# EasyEDA Pro project sle_keyboard.eprj, board PCB1 (continued)
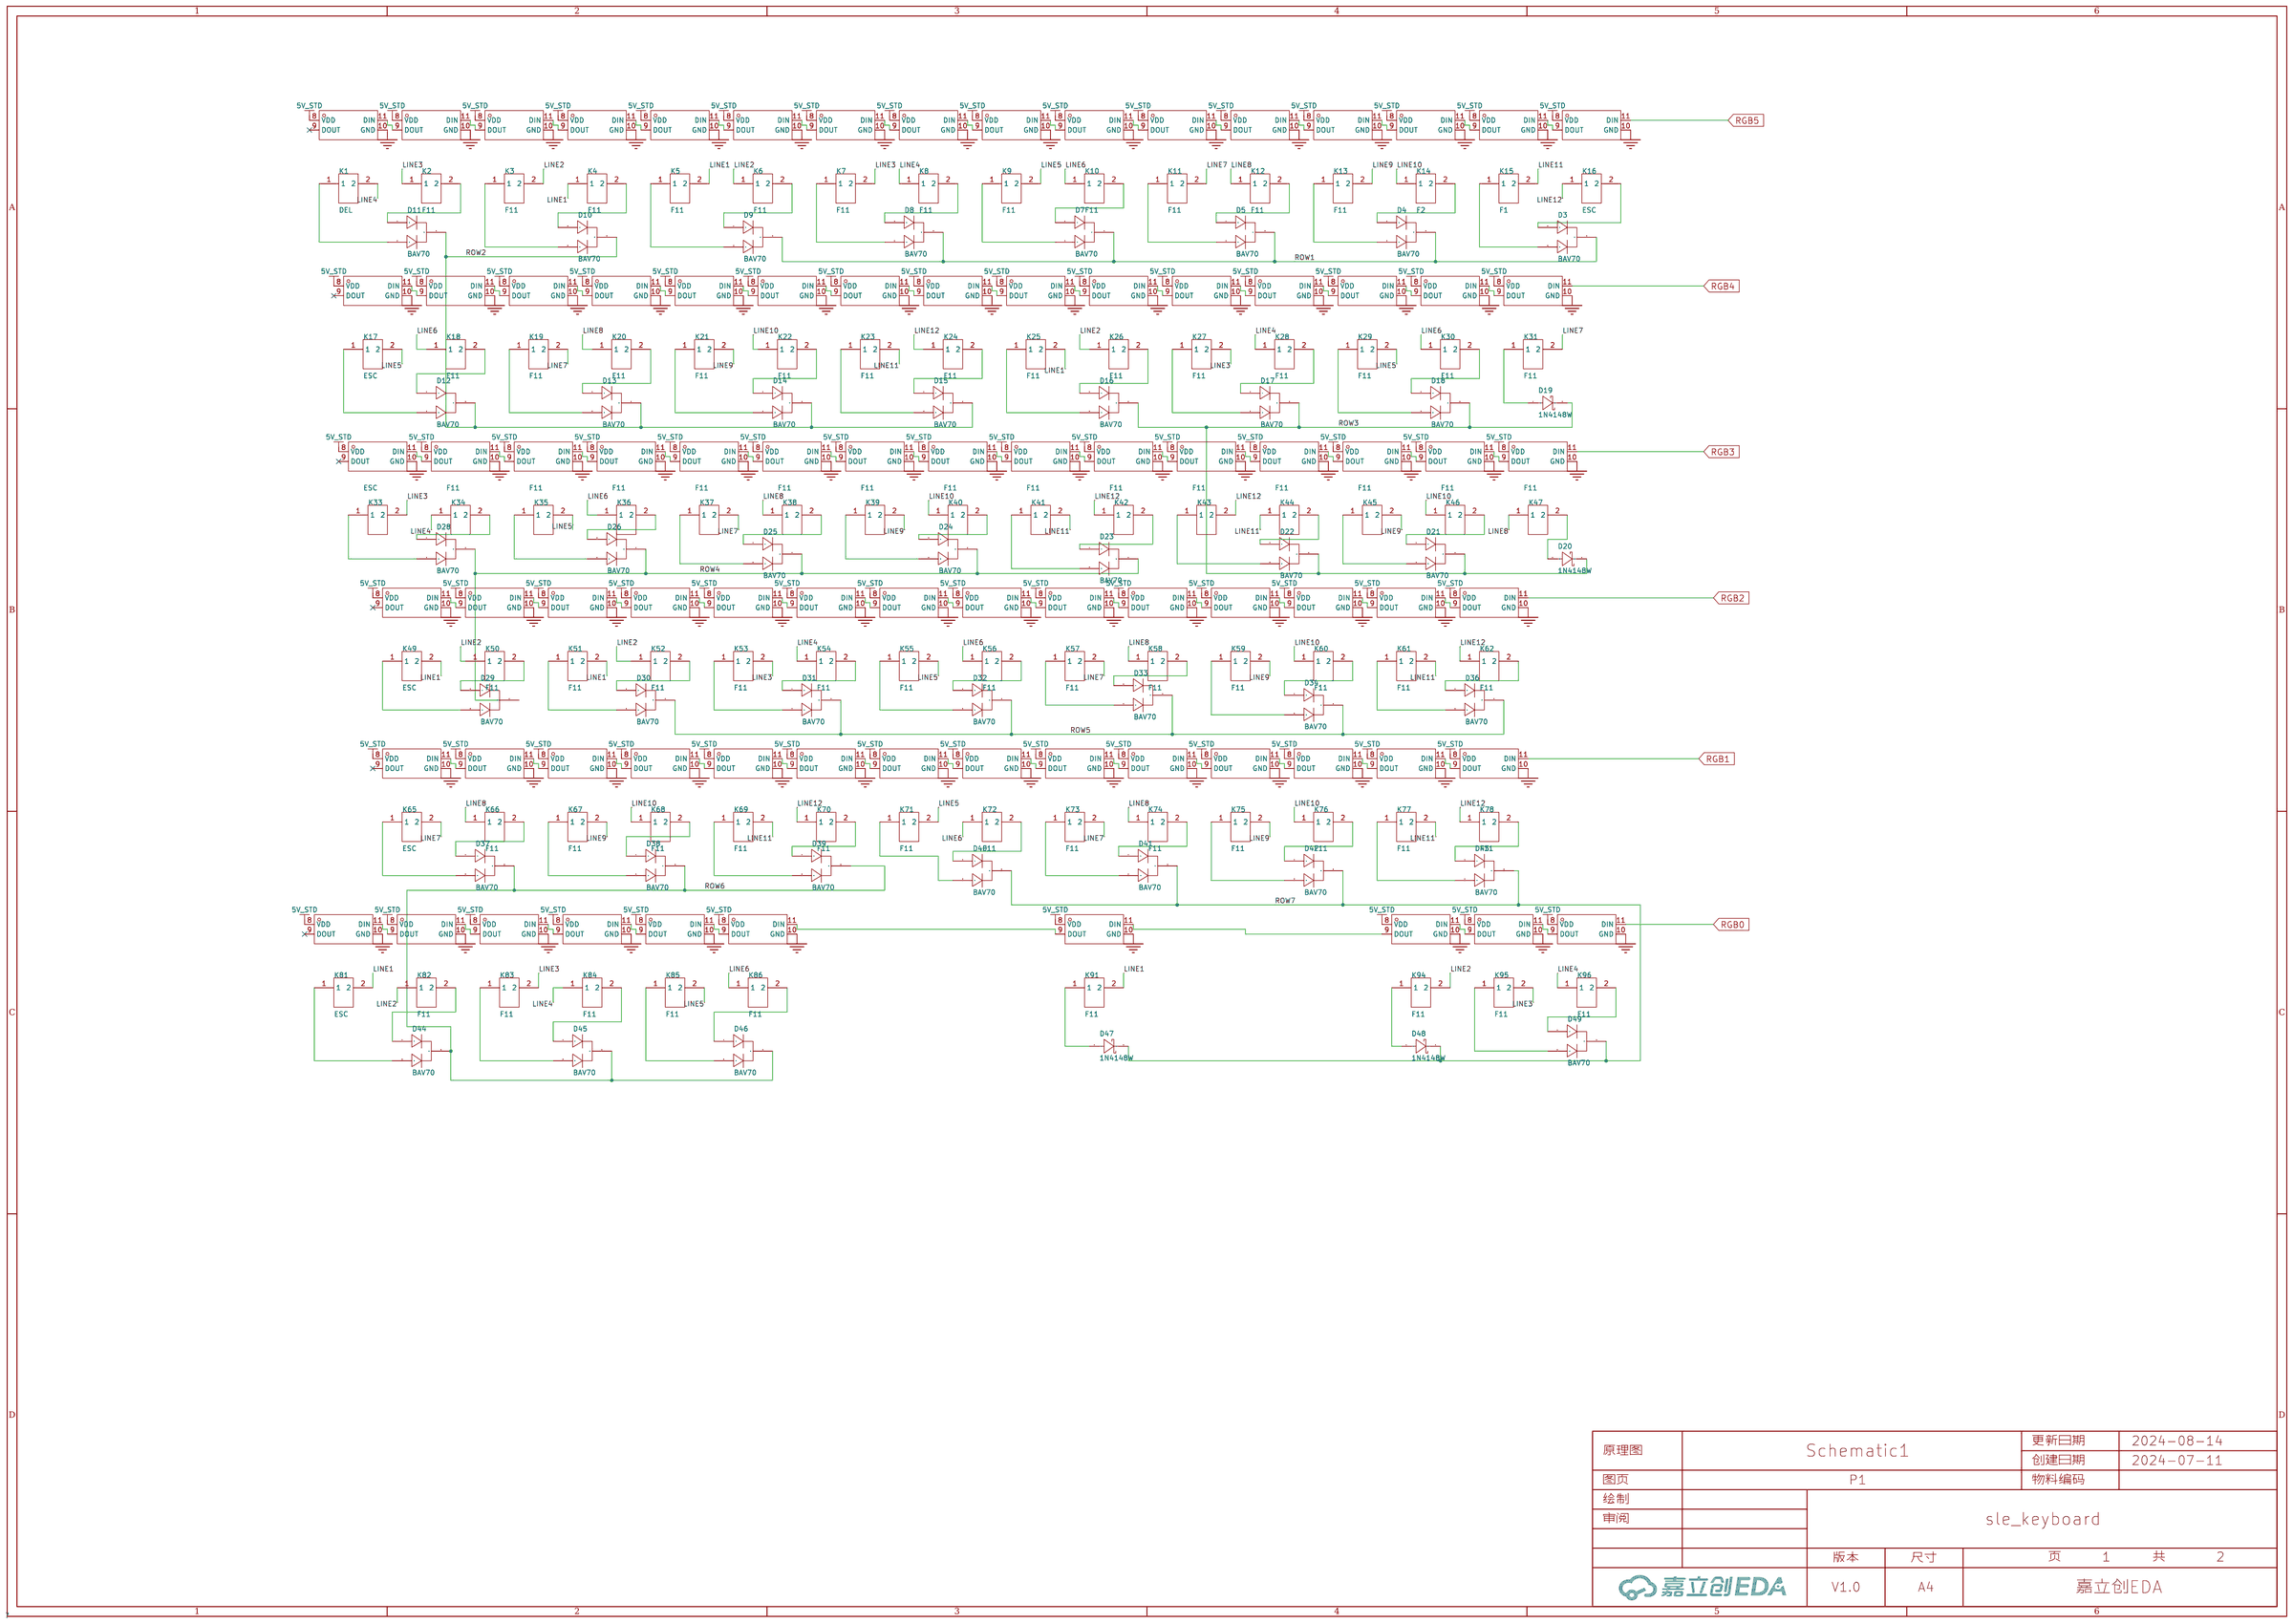
[diagram p0: P1]
## Routing (per net, layer and track width the routed paths; a pad name or vN(x,y) marks a point on that pad's centre or on a via; arc(x,y) is an arc through that point) (continued)
  Bottom Layer w0.178: v1(170.56,63.75) 169.55,62.74 169.55,46.86 167.39,44.7 166.88,44.7 165.74,43.56 165.74,20.32 v1(164.85,19.43) ; v1(180.59,64.39) 180.47,64.26 v1(179.07,64.26) ; v1(28.68,46.89) 28.68,60.55 25.87,63.37 25.87,69.67 25.07,70.47 ; v1(168.28,12.95) 167.89,13.34 v1(167.89,18.42)
ROW5: length 288.4
  Top Layer w0.178: 168.25,11.7 175.22,11.7 176.12,10.8 185.15,10.8 185.75,10.2 188.42,10.2 ; 117.94,52.21 116.75,52.21 114.77,50.22 81.43,50.22 80.55,49.34 80.55,46.55 ; 117.94,52.21 122.68,52.21 124.47,50.42 156.5,50.42 ; 117.94,52.21 118.5,51.64 118.5,48.16 118.51,48.15 ; 156.5,50.42 156.97,49.95 156.97,47.36 157,47.32 ; 156.5,50.42 195.18,50.42 ; 195.64,47.51 195.6,47.56 195.6,50 195.18,50.42 ; 233.52,47.4 233.33,47.58 233.33,49.94 232.85,50.42 195.18,50.42 ; 233.28,47.4 233.28,40.88 234.25,39.91 271.61,39.91 273.24,41.54 ; v1(168.84,39.88) 166.21,42.51 157.4,42.51 157.09,42.82 157.09,47.2 156.97,47.31
  Bottom Layer w0.178: 168.79,39.89 167.77,40.91 167.45,40.91 167.17,40.63 167.17,12.7 v1(168.2,11.67)
ROW6: length 330.9
  Top Layer w0.178: v1(113.79,20.45) 112.4,21.84 109.35,21.84 ; 19.14,9.6 19.14,11.04 v1(19.02,11.16) ; D45.3 56.64,8.3 56.64,1.91 56.52,1.78 ; 109.35,21.84 D39.3 ; 109.35,21.84 106.81,19.3 66.29,19.3 ; v1(180.72,9.91) 180.85,9.91 184.02,6.73 v1(184.02,5.08) 184.84,4.27 185.5,4.27 185.67,4.45 187.05,4.45 189.72,7.11 189.72,7.7 ; D38.3 67.31,26.84 67.31,20.32 66.29,19.3 ; v1(164.47,7.75) 163.96,7.24 160.02,7.24 158.24,5.46 118.75,5.46 v1(113.79,10.41) ; 66.29,19.3 23.88,19.3 18.8,24.38 D37.3 ; 56.52,1.78 21.46,1.78 19.05,4.19 D44.3 ; 56.52,1.78 94.49,1.78 95,2.29 95,8.3 D46.3
  Bottom Layer w0.178: v1(180.72,9.91) 178.31,12.32 171.2,12.32 169.93,11.05 167.89,11.05 167.39,10.54 167.39,8.76 167,8.38 165.1,8.38 v1(164.47,7.75) ; 18.8,27.31 15.88,24.39 15.88,17.3 19.02,14.16 v1(19.02,11.16) ; v1(113.79,20.45) v1(113.79,10.41)
  vias: v1(18.79,27.34)
ROW7: length 245.8
  Top Layer w0.178: 267.39,25.1 267.49,25.2 267.49,29.76 266.24,31.01 229.89,31.01 228.35,32.54 223.16,32.54 ; 223.16,32.54 223.26,32.45 223.26,28.97 223.24,28.96 ; 223.16,32.54 222.18,32.54 221.43,31.79 189.1,31.79 188.51,32.39 185.88,32.39 184.83,31.34 184.83,28.22 ; v1(181.36,8) 182.63,6.73 182.63,4.45 183.13,3.94 186.95,3.94 190.12,7.11 190.12,7.7 ; v1(267.47,23.54) 267.41,23.61 267.41,24.85 ; 282.01,4.84 281.99,4.86 278.57,4.86 276.44,6.98 276.44,10.91 275.58,11.77 265.51,11.77 263.16,14.13 257.33,14.13 256.45,13.25 256.45,12.5 ; 147.49,28.04 147.49,24.13 151.44,20.18 v1(181.96,20.18) 184.14,20.18 185.55,21.59 185.55,27.01 184.83,27.72 ; 161.29,6.17 161.89,5.57 161.89,3.57
  Bottom Layer w0.178: v1(181.96,20.18) 181.96,8.61 v1(181.36,8) ; v1(266.38,11.81) 266.38,22.46 267.47,23.54 ; v1(161.19,6.21) 147.46,19.94 147.46,24.15
  vias: v1(147.47,24.16)
SLE_3V3: length 86.9
  Top Layer w0.127: v2(188.61,14.61) U1.48
  Top Layer w0.508: C5.1 v2(187.38,14.61) v2(188.61,14.61) ; C8.1 195.51,15.36 v2(194.75,14.6) v2(194.75,13.83) 194.75,13.21 ; 186.22,7.27 v2(187.8,7.24) v2(188.56,7.24)
  Top Layer w0.762: C22.1 154.21,10.06 Q1.2 U5.1
  Top Layer w1.016: v1(152.65,7.87) 152.78,8 153.42,8 v1(153.54,7.87) 153.67,8 154.36,8 v1(154.48,7.87)
  Bottom Layer w0.127: v2(188.61,14.61) 188.61,14.6
  Bottom Layer w0.508: 188.61,13.83 188.16,13.83 v2(187.38,14.61) v1(187.38,13.7) 187.38,7.65 v2(187.8,7.24) ; 188.61,13.83 v1(188.61,8) 188.61,7.29 v2(188.56,7.24) ; 188.61,13.83 v2(194.75,13.83) ; 188.61,13.83 v2(188.61,14.61) ; v2(194.75,14.6) 188.61,14.6
  Bottom Layer w0.762: v1(188.61,8) v1(187.74,8) 187.19,8 186.18,6.99 175.26,6.99 172.59,4.32 160.53,4.32 156.97,7.87 v1(154.48,7.87) v1(153.54,7.87) v1(152.65,7.87) ; v1(153.54,8.64) v1(152.65,8.64) v1(151.89,8.64)
  vias: v1(187.89,14.13) v1(188.59,13.72)
SLE_DBG_RX: length 9.3
  Top Layer w0.178: NOREF#9.TP4 188.98,1.52 190.12,1.52 191.01,2.41 192.02,2.41 192.91,3.3 192.91,5.84 193.32,6.25 193.32,7.7
SLE_DBG_TX: length 11.4
  Top Layer w0.178: NOREF.TP5 187.33,2.41 190.25,2.41 190.63,2.79 191.9,2.79 192.53,3.43 192.53,6.1 192.92,6.48 192.92,7.7
SLE_USB_N: length 133.3
  Top Layer w0.203: v1(183.77,9.91) 183.83,9.91 183.97,9.77 187.79,9.77 187.81,9.8 U1.9
  Top Layer w0.28: 228.22,91.11 228.22,91.53 228.51,91.83 228.51,91.97 227.64,92.84 209.04,92.84 v1(208.41,93.47) ; 227.08,91.24 228.22,91.24
  Bottom Layer w0.28: v1(208.41,93.47) 208.66,93.22 208.66,79.25 212.04,75.87 212.04,65.74 207.47,61.16 207.47,46.69 203.91,43.13 203.91,22.02 202.49,20.6 187.25,20.6 186.26,19.61 186.26,13.16 184.28,11.18 184.28,10.86 183.77,10.35 v1(183.77,9.91)
SLE_USB_P: length 133.3
  Top Layer w0.203: 184.15,9.15 184.42,9.42 187.79,9.42 187.81,9.4 U1.10
  Top Layer w0.28: v1(209.3,93.47) 209.5,93.27 227.95,93.27 228.94,92.27 228.94,91.95 229.24,91.66 R12.2 230.38,91.24
  Bottom Layer w0.28: v1(209.3,93.47) 209.09,93.27 209.09,79.43 212.47,76.05 212.47,65.56 207.9,60.99 207.9,46.51 204.34,42.95 204.34,21.84 202.66,20.17 187.42,20.17 186.69,19.43 186.69,12.98 184.71,11 184.71,9.7 v1(184.15,9.14)
SWD_CLK: length 3.6
  Top Layer w0.254: NOREF#3.TP2 194.69,2.16 R2.2
SWD_DAT: length 3.4
  Top Layer w0.254: R1.2 196.72,1.65 NOREF#8.TP1
SYS_3V3: length 167.2
  Top Layer w0.178: v1(21.02,46.89) 20.31,46.18 20.07,46.18
  Top Layer w0.254: v1(150.5,14.86) 150.06,15.29 R21.2
  Top Layer w1.016: 149.13,10.8 v1(146.08,10.8) 137.16,10.8 129.54,18.42 v1(42.55,18.42) v1(41.79,18.42) v1(41.01,18.42)
  Bottom Layer w0.254: v1(150.5,14.86) 146.43,10.8 v1(146.08,10.8) ; 26.41,47.24 21.37,47.24 v1(21.02,46.89)
  Bottom Layer w0.762: 26.41,47.24 26.42,47.24
  Bottom Layer w1.016: 26.42,51.29 26.41,51.28 26.41,46.38 39.32,33.47 39.32,19.86 40.74,18.44 43.52,18.44
  vias: v1(25.75,51.83) v1(25.7,51.05) v1(26.42,51.08) v1(26.45,51.84) v1(27.11,51.83) v1(27.12,51.09)
USB_N: length 22.6
  Top Layer w0.28: R9.1 228.45,88.34 228.55,88.24 228.55,86.49 229.18,85.85 231.24,85.85 233.68,88.29 243.2,88.29 243.55,88.65 243.55,91.31 243.93,91.69 CN2.3
USB_P: length 22.8
  Top Layer w0.28: CN2.4 244.78,92.96 243.59,92.96 243.12,92.49 243.12,88.82 243.02,88.73 233.5,88.73 231.06,86.28 229.36,86.28 228.98,86.66 228.98,88.24 229.08,88.34 R10.1
$1N13661: length 13.1
  Top Layer w0.178: v1(243.22,109.06) 243.09,109.2 241.24,109.2 ; 253.68,110.69 251.46,110.69 250.08,109.31
  Bottom Layer w0.178: 243.25,109.1 249.88,109.1 v1(250.07,109.28)
$1N13668: length 12.9
  Top Layer w0.178: 272.83,110.87 270.12,110.87 269.84,110.59 ; 260.51,109.16 v1(262.26,109.16)
  Bottom Layer w0.178: v1(269.77,110.56) 268.38,109.16 v1(262.26,109.16)
$1N13672: length 14.2
  Top Layer w0.178: 279.75,109.04 281.34,109.04 v1(281.43,109.12) ; 292.33,110.58 291.26,111.66 291.26,111.68
  Bottom Layer w0.178: v1(281.43,109.12) 284.01,111.71 v1(291.27,111.71)
$1N13676: length 13.2
  Top Layer w0.178: 222.19,109.12 224.14,109.12 v1(224.17,109.16) ; 234.79,110.6 231.59,110.6 230.92,109.93
  Bottom Layer w0.178: v1(224.17,109.16) 230.17,109.16 v1(230.91,109.89)
$1N13680: length 14.1
  Top Layer w0.178: v1(205.2,109.04) 205.03,109.21 202.85,109.21 ; 216.15,110.57 212.87,110.57 212.15,109.85
  Bottom Layer w0.178: v1(212.11,109.84) 211.33,109.06 205.09,109.06
$1N13684: length 13.6
  Top Layer w0.178: 196.87,110.56 194.26,110.56 192.82,109.12 ; 183.96,109.23 185.73,109.23 v1(185.82,109.15)
  Bottom Layer w0.178: v1(185.82,109.15) 185.85,109.12 v1(192.84,109.12)
$1N13688: length 13.5
  Top Layer w0.178: 164.91,109.11 v1(167.73,109.11) ; 177.77,110.61 174.56,110.61 173.59,109.63
  Bottom Layer w0.178: v1(173.62,109.67) 173.05,109.11 v1(167.73,109.11)
$1N13692: length 13.5
  Top Layer w0.178: 145.83,109.13 145.87,109.17 151.99,109.17 153.41,110.59 158.77,110.59
$1N13696: length 13.4
  Top Layer w0.178: 131.78,109.01 131.75,109.04 127.01,109.04 ; 134.75,109.27 136.23,110.76 139.72,110.76
  Bottom Layer w0.178: v1(131.73,109.09) 134.62,109.09 v1(134.72,109.19)
$1N13700: length 13.8
  Top Layer w0.178: 120.81,110.67 114.56,110.67 113.01,109.13 107.65,109.13 107.64,109.15
$1N13704: length 13.7
  Top Layer w0.178: 88.67,109.13 91.87,109.13 v1(91.88,109.13) ; 96.36,109.13 97.72,110.48 101.79,110.48
  Bottom Layer w0.178: v1(91.88,109.13) 91.92,109.16 v1(96.39,109.16)
$1N13708: length 15
  Top Layer w0.178: 82.62,110.52 82.62,111.15 81.93,111.84 ; 69.69,109.11 71.69,109.11 v1(71.79,109.21)
  Bottom Layer w0.178: v1(71.79,109.21) 74.43,111.85 v1(81.93,111.85)
$1N13712: length 13.2
  Top Layer w0.178: 50.89,108.99 54.59,108.99 54.67,109.07 ; 63.18,110.51 62.88,110.8 58.72,110.8
  Bottom Layer w0.178: v1(58.73,110.78) 56.97,109.01 v1(54.66,109.01)
$1N13716: length 13.6
  Top Layer w0.178: 31.31,109.17 31.32,109.16 37.46,109.16 38.82,110.52 44.36,110.52
$1N13720: length 13.9
  Top Layer w0.178: v1(16.5,109.39) 16.26,109.15 12.44,109.15 ; 25.75,110.64 19.88,110.64 19.21,109.97
  Bottom Layer w0.178: v1(19.21,109.96) 18.66,109.4 16.54,109.4
$1N13724: length 23.7
  Top Layer w0.178: 35.3,91.8 28.59,91.8 28.31,92.09 ; 16.25,91.25 14.94,89.95 12.62,89.95 ; 18.83,91.45 19.42,92.04 v1(24.42,92.04)
  Bottom Layer w0.178: v1(16.3,91.46) 16.3,91.46 v1(18.88,91.46) ; v1(28.4,92.07) 24.44,92.07 24.4,92.03
$1N13728: length 24.6
  Top Layer w0.178: 57.96,89.83 59.6,91.46 63.67,91.46 ; 41.15,90.16 54.24,90.16 55.66,91.58
  Bottom Layer w0.178: v1(57.99,89.74) 57.61,89.74 v1(55.71,91.65)
$1N13732: length 14.3
  Top Layer w0.178: 82.06,91.9 81.57,91.9 79.69,90.02 76.36,90.02 74.6,91.78 73.06,91.78 ; v1(71.11,90.11) 71.06,90.06 69.93,90.06
  Bottom Layer w0.178: v1(71.11,90.11) 71.3,90.11 v1(72.99,91.79)
$1N13736: length 14.2
  Top Layer w0.178: 101.48,91.81 100.74,92.56 v1(100.74,92.58) ; 88.67,90.04 95.67,90.04 v1(98.16,92.53)
  Bottom Layer w0.178: v1(98.16,92.53) 98.21,92.58 v1(100.74,92.58)
$1N13740: length 14
  Top Layer w0.178: 116.84,92.65 114.3,90.11 108.08,90.11 ; 120.46,91.43 119.32,92.58 119.2,92.58
  Bottom Layer w0.178: 116.81,92.69 116.88,92.62 v1(119.22,92.62)
  vias: v1(116.86,92.61)
$1N13744: length 14.1
  Top Layer w0.178: 136.88,91.1 135.78,89.99 127.23,89.99 ; 139.92,91.53 139.39,91.53 v1(138.44,92.48)
  Bottom Layer w0.178: v1(138.44,92.48) 137.1,91.14 v1(136.87,91.14)
$1N13748: length 13.4
  Top Layer w0.178: 145.81,90.14 155.3,90.14 155.36,90.08 ; 158.38,91.55 158.16,91.32 157.6,91.32 ; 155.37,90.08 155.79,89.67
  Bottom Layer w0.178: v1(157.47,91.38) 155.8,89.7 155.8,89.7
  vias: v1(155.8,89.66)
$1N13752: length 13.4
  Top Layer w0.178: 175.79,92.22 176.31,91.7 177.53,91.7 ; 165.26,90.09 171.85,90.09 173.94,92.17
  Bottom Layer w0.178: v1(175.81,92.19) 173.94,92.19 v1(173.93,92.2)
$1N13756: length 13.6
  Top Layer w0.178: 193.71,90.63 193.15,90.07 184.08,90.07 ; 196.78,91.63 195.71,91.63 195.25,92.1
  Bottom Layer w0.178: v1(193.77,90.69) 195.19,92.11 v1(195.24,92.11)
$1N13760: length 15.8
  Top Layer w0.178: 207.14,89.49 203.32,89.49 202.84,89.96 ; 215.84,91.69 207.83,91.69 207.49,92.04
  Bottom Layer w0.178: v1(207.54,92.14) 207.54,89.74 v1(207.28,89.48)
$1N13764: length 16.9
  Top Layer w0.178: 222.15,90.29 224.5,90.29 225.59,89.2 226.1,89.2 226.59,88.71 ; 233.76,92.94 234.93,91.78 234.93,91.63
  Bottom Layer w0.178: v1(226.54,88.78) 231.54,88.78 232.61,89.86 232.61,91.88 v1(233.68,92.96)
$1N13768: length 30.3
  Top Layer w0.178: 253.85,91.53 254.09,91.77 254.09,93.02 ; 251.39,91.54 251.38,91.53 v1(249.36,91.53)
  Top Layer w0.508: K28.11 241.07,90.04 v1(242.44,90.04)
  Bottom Layer w0.178: v1(242.44,90.04) 242.44,91.34 239.46,94.33 239.46,96.81 247.14,96.81 249.34,94.6 249.34,91.56 ; v1(251.33,91.55) 252.84,93.06 v1(254.11,93.06)
$1N13772: length 19.3
  Top Layer w0.178: 262.46,95.59 268.83,95.59 272.77,91.66 ; v1(262.41,90.15) 262.3,90.04 260.51,90.04
  Bottom Layer w0.178: v1(262.41,90.15) 262.44,90.18 v1(262.44,95.57)
$1N13776: length 13.2
  Top Layer w0.178: 292.27,91.66 292.21,91.59 286.44,91.59 285.08,90.23 279.7,90.23
$1N13780: length 20.6
  Top Layer w0.178: 30.36,72.58 23.45,72.58 22.26,71.4 ; 13.01,70.92 13.4,70.92 14.56,72.08 ; v1(15.61,70.18) 15.62,70.19 17.58,70.19 19.25,71.86 v1(20.29,71.86)
  Bottom Layer w0.178: v1(14.61,72.15) 15.61,71.15 v1(15.61,70.18) ; v1(22.33,71.4) 21.87,71.86 v1(20.29,71.86)
$1N13784: length 19.2
  Top Layer w0.178: 54.04,72.42 53.02,73.44 52.28,73.44 ; 49.17,73.44 46.67,70.94 36.33,70.94
  Bottom Layer w0.178: v1(49.23,73.45) 52.34,73.45 v1(52.38,73.41)
$1N13788: length 14.5
  Top Layer w0.178: 72.88,72.58 71.68,73.78 70.63,73.78 ; 68.57,73.8 65.75,70.98 59.99,70.98
  Bottom Layer w0.178: v1(70.65,73.79) 68.66,73.79 v1(68.64,73.82)
$1N13792: length 15.7
  Top Layer w0.178: 92.27,72.6 90.79,72.6 90.68,72.49 ; 90.62,70.2 89.67,70.2 88.85,71.02 79.08,71.02
  Bottom Layer w0.178: v1(90.54,72.44) 90.54,70.46 v1(90.67,70.34)
$1N13796: length 14.1
  Top Layer w0.178: 110.94,72.7 108.88,72.7 108.83,72.75 ; 98.17,71.02 106,71.02 106.48,70.55
  Bottom Layer w0.178: v1(106.42,70.53) 106.64,70.53 v1(108.91,72.81)
$1N13800: length 14.6
  Top Layer w0.178: v1(127.83,71.5) 127.22,70.89 117.52,70.89 ; 129.61,73.55 130,73.15 130,72.5
  Bottom Layer w0.178: v1(129.58,73.6) 127.83,71.85 v1(127.83,71.5)
$1N13804: length 14.7
  Top Layer w0.178: 149.51,72.52 144.64,72.52 143.75,73.42 ; 136.37,71.03 141.28,71.03 142.68,72.43
  Bottom Layer w0.178: v1(143.77,73.42) 142.64,72.29 v1(142.57,72.29)
$1N13808: length 13.8
  Top Layer w0.178: 155.39,71.04 155.41,71.01 162.17,71.01 163.73,72.57 168.52,72.57
$1N13812: length 13.9
  Top Layer w0.178: 174.32,70.98 174.37,71.02 179.44,71.02 180.96,72.54 187.57,72.54
$1N13816: length 13.6
  Top Layer w0.178: 193.43,71.02 193.44,71.03 197.7,71.03 199.26,72.59 206.36,72.59
$1N13820: length 13.7
  Top Layer w0.178: 224.21,72.3 224.82,72.3 225.05,72.53 225.71,72.53 ; v1(222.86,71.06) 222.7,71.22 213.28,71.22 213.03,70.98
  Bottom Layer w0.178: v1(224.19,72.28) 224.19,71.85 223.41,71.06 v1(222.86,71.06)
$1N13824: length 16.4
  Top Layer w0.178: 242.07,72.2 242.37,72.49 244.77,72.49 ; 231.39,71.15 233.93,71.15 235.58,69.5 241.41,69.5 241.97,70.06
  Bottom Layer w0.178: v1(242.05,72.22) 242.05,70.18 v1(242.03,70.16)
$1N13828: length 14.2
  Top Layer w0.178: 258.96,72.3 257.7,71.03 251.14,71.03 ; 263.79,72.54 261.72,72.54 260.63,73.63
  Bottom Layer w0.178: v1(259,72.33) 259.36,72.33 v1(260.67,73.63)
$1N13832: length 19.4
  Top Layer w0.178: v1(275.83,70.99) 275.73,70.89 269.69,70.89 ; 285.45,74.03 285.76,74.03 287.21,72.58
  Bottom Layer w0.178: v1(285.43,74.04) 278.82,74.04 275.82,71.05
$1N13836: length 33
  Top Layer w0.178: 37.15,54.83 37.01,54.69 37.01,53.37 ; 12.55,51.94 13.96,51.94 14.74,52.72 ; 14.76,56.96 15.55,57.75 v1(30.79,57.75)
  Bottom Layer w0.178: 30.79,57.73 31.26,57.26 31.26,55.77 31.37,55.66 36.19,55.66 v1(37.07,54.78) ; v1(14.78,56.97) 14.78,52.8 v1(14.75,52.78)
$1N13840: length 29.4
  Top Layer w0.178: 43.89,52.07 64.23,52.07 66.39,49.91 ; 68.11,53.51 67.3,54.32 66.95,54.32
  Bottom Layer w0.178: v1(66.4,49.94) 66.71,50.25 v1(66.71,54.3)
$1N13844: length 15.7
  Top Layer w0.178: 74.75,52.07 84.47,52.07 85.04,51.5 ; 87.79,53.42 87.79,54.36 87.73,54.42
  Bottom Layer w0.178: v1(85.05,51.5) 87.73,54.18 v1(87.73,54.53)
$1N13848: length 13.1
  Top Layer w0.178: 93.74,52 93.81,52.07 99.26,52.07 100.58,53.4 106.26,53.4
$1N13852: length 16
  Top Layer w0.178: 121.33,53.08 113.89,53.08 112.73,51.92 ; 125.74,53.54 124.06,53.54 123.88,53.36
  Bottom Layer w0.178: v1(123.95,53.45) 123.95,52.05 123.65,51.76 122.09,51.76 121.4,52.46 v1(121.4,53.05)
$1N13856: length 16
  Top Layer w0.178: 144.61,53.43 144.61,54.39 ; 142.12,51.3 141.6,51.82 131.39,51.82
  Bottom Layer w0.178: v1(142.14,51.3) 144.63,53.79 v1(144.63,54.4)
$1N13904: length 21.6
  Top Layer w0.178: 284.83,53.37 283.27,54.93 281.62,54.93 ; 265.05,51.98 271.31,51.98 274.23,54.91
  Bottom Layer w0.178: v1(281.58,54.94) 274.28,54.94 v1(274.25,54.91)
$1N13908: length 14.7
  Top Layer w0.178: 256.03,55.35 256.36,55.35 258.32,53.39 ; 245.76,51.98 252.58,51.98 254.08,53.48
  Bottom Layer w0.178: v1(254.14,53.49) 254.14,53.54 v1(256,55.41)
$1N13916: length 19.7
  Top Layer w0.178: 239.45,55.12 239.7,54.87 239.7,53.4 ; 239.59,50.42 239.58,50.41 238.04,50.41 236.51,51.94 227.19,51.94
  Bottom Layer w0.178: v1(239.42,55.17) 239.42,50.72 v1(239.66,50.48)
$1N13920: length 14.6
  Top Layer w0.178: 220.63,53.39 219.41,54.61 217.17,54.61 ; 207.69,52.02 214.45,52.02 215.46,53.03
  Bottom Layer w0.178: v1(217.2,54.62) 215.56,52.99 v1(215.45,52.99)
$1N13924: length 14.6
  Top Layer w0.178: 201.89,53.41 200.9,53.41 200.26,54.05 ; 188.43,52.08 195.83,52.08 197.79,54.04
  Bottom Layer w0.178: v1(200.32,54.04) v1(197.8,54.04)
$1N13928: length 15.2
  Top Layer w0.178: 169.69,51.98 179.33,51.98 v1(179.74,51.57) ; 182.5,53.55 181.73,54.31 181.22,54.31
  Bottom Layer w0.178: v1(179.74,51.57) 181.23,53.07 v1(181.23,54.34)
$1N13932: length 14.7
  Top Layer w0.178: 159.47,54.03 157.46,52.03 150.25,52.03 ; 163.78,53.37 162.44,53.37 161.76,54.05
  Bottom Layer w0.178: v1(161.78,54.06) 159.51,54.06 v1(159.46,54.01)
$1N13936: length 26.9
  Top Layer w0.178: 273.35,33.41 272.71,32.77 255.1,32.77 ; 280.38,34.28 279.04,35.62 276.95,35.62
  Bottom Layer w0.178: v1(273.37,33.47) 274.58,33.47 v1(276.86,35.75)
$1N13940: length 15.9
  Top Layer w0.178: 249.47,34.35 248.86,34.96 247.95,34.96 ; 246.44,31.99 245.57,32.86 236.35,32.86
  Bottom Layer w0.178: v1(248.01,34.98) 246.43,33.41 v1(246.43,32)
$1N13944: length 14.6
  Top Layer w0.178: 229.95,34.5 229.95,34.89 229.18,35.66 ; 226.9,35.49 220.87,35.49 218.19,32.81 217.2,32.81
  Bottom Layer w0.178: v1(229.18,35.6) 226.95,35.6 v1(226.91,35.56)
$1N13948: length 14.8
  Top Layer w0.178: 208.38,33.38 207.89,32.89 198.18,32.89 ; 211.43,34.41 210.5,35.34 210,35.34
  Bottom Layer w0.178: v1(209.94,35.32) 209.94,34.92 v1(208.43,33.41)
$1N13952: length 14.3
  Top Layer w0.178: 179.42,32.99 186.68,32.99 v1(189.07,35.38) ; 190.81,35.34 191.44,35.34 192.34,34.44
  Bottom Layer w0.178: v1(190.81,35.34) 190.78,35.38 v1(189.07,35.38)
$1N13956: length 18.4
  Top Layer w0.178: 173.21,35.34 173.04,35.17 173.04,34.48 ; 173.18,31.53 171.93,31.53 170.52,32.94 160.11,32.94
  Bottom Layer w0.178: v1(173.24,35.32) 173.24,31.59 v1(173.18,31.53)
$1N13960: length 14.8
  Top Layer w0.178: v1(150.13,35.45) 147.53,32.85 141.44,32.85 ; 154.19,35.39 154.2,35.38 154.2,34.44
  Bottom Layer w0.178: v1(150.13,35.45) 150.14,35.44 v1(154.21,35.44)
$1N13964: length 18.3
  Top Layer w0.178: 121.97,32.93 123.1,31.8 v1(135.18,31.8) ; 135.21,34.45 135.21,35.29 135.29,35.38
  Bottom Layer w0.178: v1(135.18,31.8) 135.26,31.87 v1(135.26,35.4)
$1N13968: length 18
  Top Layer w0.178: 116.07,34.47 115.23,35.31 115.09,35.31 ; 103.1,33.07 112.6,33.07 114.28,31.4 115.11,31.4 115.13,31.37
  Bottom Layer w0.178: v1(115.19,31.36) 115.13,31.41 v1(115.13,35.3)
$1N13972: length 17.4
  Top Layer w0.178: 97.09,34.41 97.09,34.47 96.24,35.33 ; v1(96.16,31.88) 96.14,31.87 94.94,31.87 93.92,32.89 83.98,32.89
  Bottom Layer w0.178: v1(96.22,35.36) 96.22,31.95 v1(96.16,31.88)
$1N13976: length 35.6
  Top Layer w0.178: 13.51,32.86 13.5,32.87 ; 13.51,32.86 12.61,32.86 ; 13.51,32.86 13.57,32.86 14.96,31.46 16.64,31.46 17.05,31.88 20.68,31.88 22.2,30.36 v1(22.62,30.36) ; 25.59,35.8 25.48,35.69 25.48,34.34
  Bottom Layer w0.178: v1(25.59,35.62) 33.06,35.62 33.25,35.43 33.25,31.71 32.41,30.87 27.18,30.87 26.6,30.3 22.65,30.3 22.6,30.35
$1N13980: length 24.6
  Top Layer w0.178: 51.33,34.43 51.33,34.9 50.85,35.39 ; 31.83,32.89 39.08,32.89 42.91,36.72 50.77,36.72 51.28,37.23 51.42,37.23
  Bottom Layer w0.178: v1(50.8,35.4) 51.39,35.99 v1(51.39,37.25)
$1N13984: length 24.8
  Top Layer w0.178: 76.74,31.86 58.68,31.86 57.51,33.03 ; 76.82,35.27 77.17,35.27 78.02,34.42
  Bottom Layer w0.178: v1(76.77,35.32) 76.77,31.86 v1(76.74,31.84)
$1N13988: length 15.9
  Top Layer w0.178: 12.8,14.03 16.01,14.03 17.32,15.33 21.78,15.33 ; 25.83,15.41 26.3,15.88 26.3,16.51
  Bottom Layer w0.178: v1(26.37,16.52) 22.97,16.52 21.79,15.34
  vias: v1(21.7,15.31)
$1N13992: length 15.2
  Top Layer w0.178: 43.18,15.39 43.2,15.38 44.65,15.38 ; 41.69,12.97 40.91,13.75 31.39,13.75
  Bottom Layer w0.178: v1(41.67,12.99) 41.67,13.91 v1(43.2,15.45)
$1N13996: length 22.4
  Top Layer w0.178: 50.52,13.87 54.22,13.87 55.72,15.36 ; v1(63.43,20.6) 63.42,20.61 v1(60.99,20.61) ; 63.51,15.5 62.97,16.05
  Bottom Layer w0.178: 61.01,20.59 60.99,20.57 58.99,20.57 58.99,18.57 v1(55.74,15.33) ; v1(62.97,16.05) 63.42,16.51 63.42,20.61
$1N14000: length 14.2
  Top Layer w0.178: 77.61,15.41 76.09,13.89 69.54,13.89 ; 81.24,15.79 81.65,15.38 82.98,15.38
  Bottom Layer w0.178: v1(81.23,15.79) 81.02,15.58 v1(77.72,15.58)
$1N14004: length 14.8
  Top Layer w0.178: 97.92,14.58 97.2,13.86 88.87,13.86 ; 101.98,15.33 101.34,15.33 100.13,16.55
  Bottom Layer w0.178: v1(100.18,16.54) 98.24,14.6 v1(97.91,14.6)
$1N14008: length 19.2
  Top Layer w0.178: v1(262.74,16.25) 256.41,16.25 254.02,13.86 248.09,13.86 ; 265.37,16.22 265.93,15.66 265.93,15.49
  Bottom Layer w0.178: v1(262.74,16.25) 262.75,16.26 v1(265.38,16.26)
$1N14012: length 20.2
  Top Layer w0.178: 272.12,13.92 283.08,13.92 286.06,16.9 ; v1(289.9,16.85) 289.88,16.83 289.88,15.68
  Bottom Layer w0.178: v1(289.9,16.85) 286.19,16.85 v1(286.11,16.93)
$1N14016: length 75
  Top Layer w0.178: v1(241.61,16.93) 241.99,16.55 241.99,15.58 ; 176.65,13.87 177.73,13.87 182.91,19.06 183.63,19.06 188.2,23.62 192.31,23.62 192.31,23.66 192.79,24.13 194.17,24.13 197.08,21.22 231.83,21.22 237.68,15.37
  Bottom Layer w0.178: v1(237.73,15.39) 239.27,16.93 v1(241.61,16.93)
$1N14021: length 73.4
  Top Layer w0.178: 170.92,15.43 168.21,15.43 167.12,14.34 167.12,10.89 164.89,8.66 164.36,8.66 163.4,7.69 159.51,7.69 158.1,6.28 139.8,6.28 130.64,15.44 130.48,15.44 130.47,15.43 129.79,15.43 128.36,13.99 107.7,13.99
$1N18227: length 7.6
  Top Layer w0.178: D19.1 302.51,81.4 301.63,80.52
$1N18268: length 3.4
  Top Layer w0.178: K47.2 283.21,64.07 283.21,67.35
$1N22738: length 17.3
  Top Layer w0.178: K91.1 180.19,3.15 178.94,1.91 166.71,1.91 D47.1
$1N22742: length 6.7
  Top Layer w0.178: D48.1 256.16,8.85 K94.1
$1N23136: length 9.2
  Top Layer w0.178: D3.2 283.46,107.59 283.46,100.45 K15.1
$1N23140: length 6.9
  Top Layer w0.178: D3.1 287.91,106.19 287.91,102.11
$1N23145: length 8.4
  Top Layer w0.178: K13.1 246.45,101.53 D4.2
$1N23152: length 5.6
  Top Layer w0.178: D4.1 248.35,103.57 K14.2
$1N23170: length 9.5
  Top Layer w0.178: D5.2 207.97,101.15 206.38,99.57
$1N23177: length 7.1
  Top Layer w0.178: D5.1 211.71,106.57 K12.2
$1N23187: length 9.3
  Top Layer w0.178: K9.1 170.25,101.53 D7.2
$1N23195: length 6.5
  Top Layer w0.178: 173.61,102.11 172.15,103.57 D7.1
$1N23205: length 8
  Top Layer w0.178: D8.2 132.15,101.53 K7.1
$1N23215: length 5.3
  Top Layer w0.178: K8.2 134.05,103.57 D8.1
$1N23225: length 8.7
  Top Layer w0.178: D9.2 93.79,101.28 92.08,99.57
$1N23232: length 6.1
  Top Layer w0.178: K6.2 95.69,103.83 D9.1
$1N23242: length 9.7
  Top Layer w0.178: D10.2 56.45,102.04 K3.1
$1N23249: length 6.6
  Top Layer w0.178: D10.1 58.35,103.07 K4.2
$1N23259: length 9.1
  Top Layer w0.178: D11.2 17.21,100.9 K1.1
$1N23269: length 6.9
  Top Layer w0.178: D11.1 19.11,104.21 K2.2
$1N23286: length 8
  Top Layer w0.178: D18.2 265.11,82.11 263.53,80.52
$1N23293: length 5.5
  Top Layer w0.178: K30.2 268.86,86 D18.1
$1N23298: length 5.2
  Top Layer w0.178: K28.2 230.76,78.89 D17.1
$1N23303: length 3.7
  Top Layer w0.178: D17.2 227.75,78.19 225.43,80.52
$1N23310: length 8.1
  Top Layer w0.178: 187.33,80.52 189.3,82.49 D16.2
$1N23317: length 5.4
  Top Layer w0.178: D16.1 191.2,84.52 K26.2
$1N23327: length 8.2
  Top Layer w0.178: D15.2 150.81,82.11 149.23,80.52
$1N23334: length 5.8
  Top Layer w0.178: D15.1 154.56,86.25 K24.2
$1N23344: length 7
  Top Layer w0.178: 111.13,80.52 112.72,82.11 D14.2
$1N23351: length 4.5
  Top Layer w0.178: K22.2 114.62,84.9 D14.1
$1N23356: length 6.6
  Top Layer w0.178: 73.03,80.52 74.36,81.85 D13.2
$1N23363: length 4.4
  Top Layer w0.178: D13.1 76.26,85.16 K20.2
$1N23466: length 6.5
  Top Layer w0.178: 15.88,80.52 16.96,81.6 D12.2
$1N23473: length 20
  Top Layer w0.254: 24.22,87.13 24.22,84.78 24.44,84.55 ; 24.22,87.16 24.22,89.7 23.59,90.33 19.77,90.33 18.83,89.39 18.83,86.66 ; 24.45,84.56 29,84.56 30.02,83.54
$1N23478: length 7.3
  Top Layer w0.178: 254,61.47 255.72,63.18 D21.2
$1N23485: length 4.7
  Top Layer w0.178: D21.1 259.34,66.31 K46.2
$1N23490: length 7.2
  Top Layer w0.178: D22.2 217.11,62.67 215.9,61.47
$1N23497: length 5.1
  Top Layer w0.178: 221.24,64.01 221.24,65.93 D22.1
